# EasyEDA Pro project kuafu01_030内部老化方案_4.eprj, board PCB4 (continued)
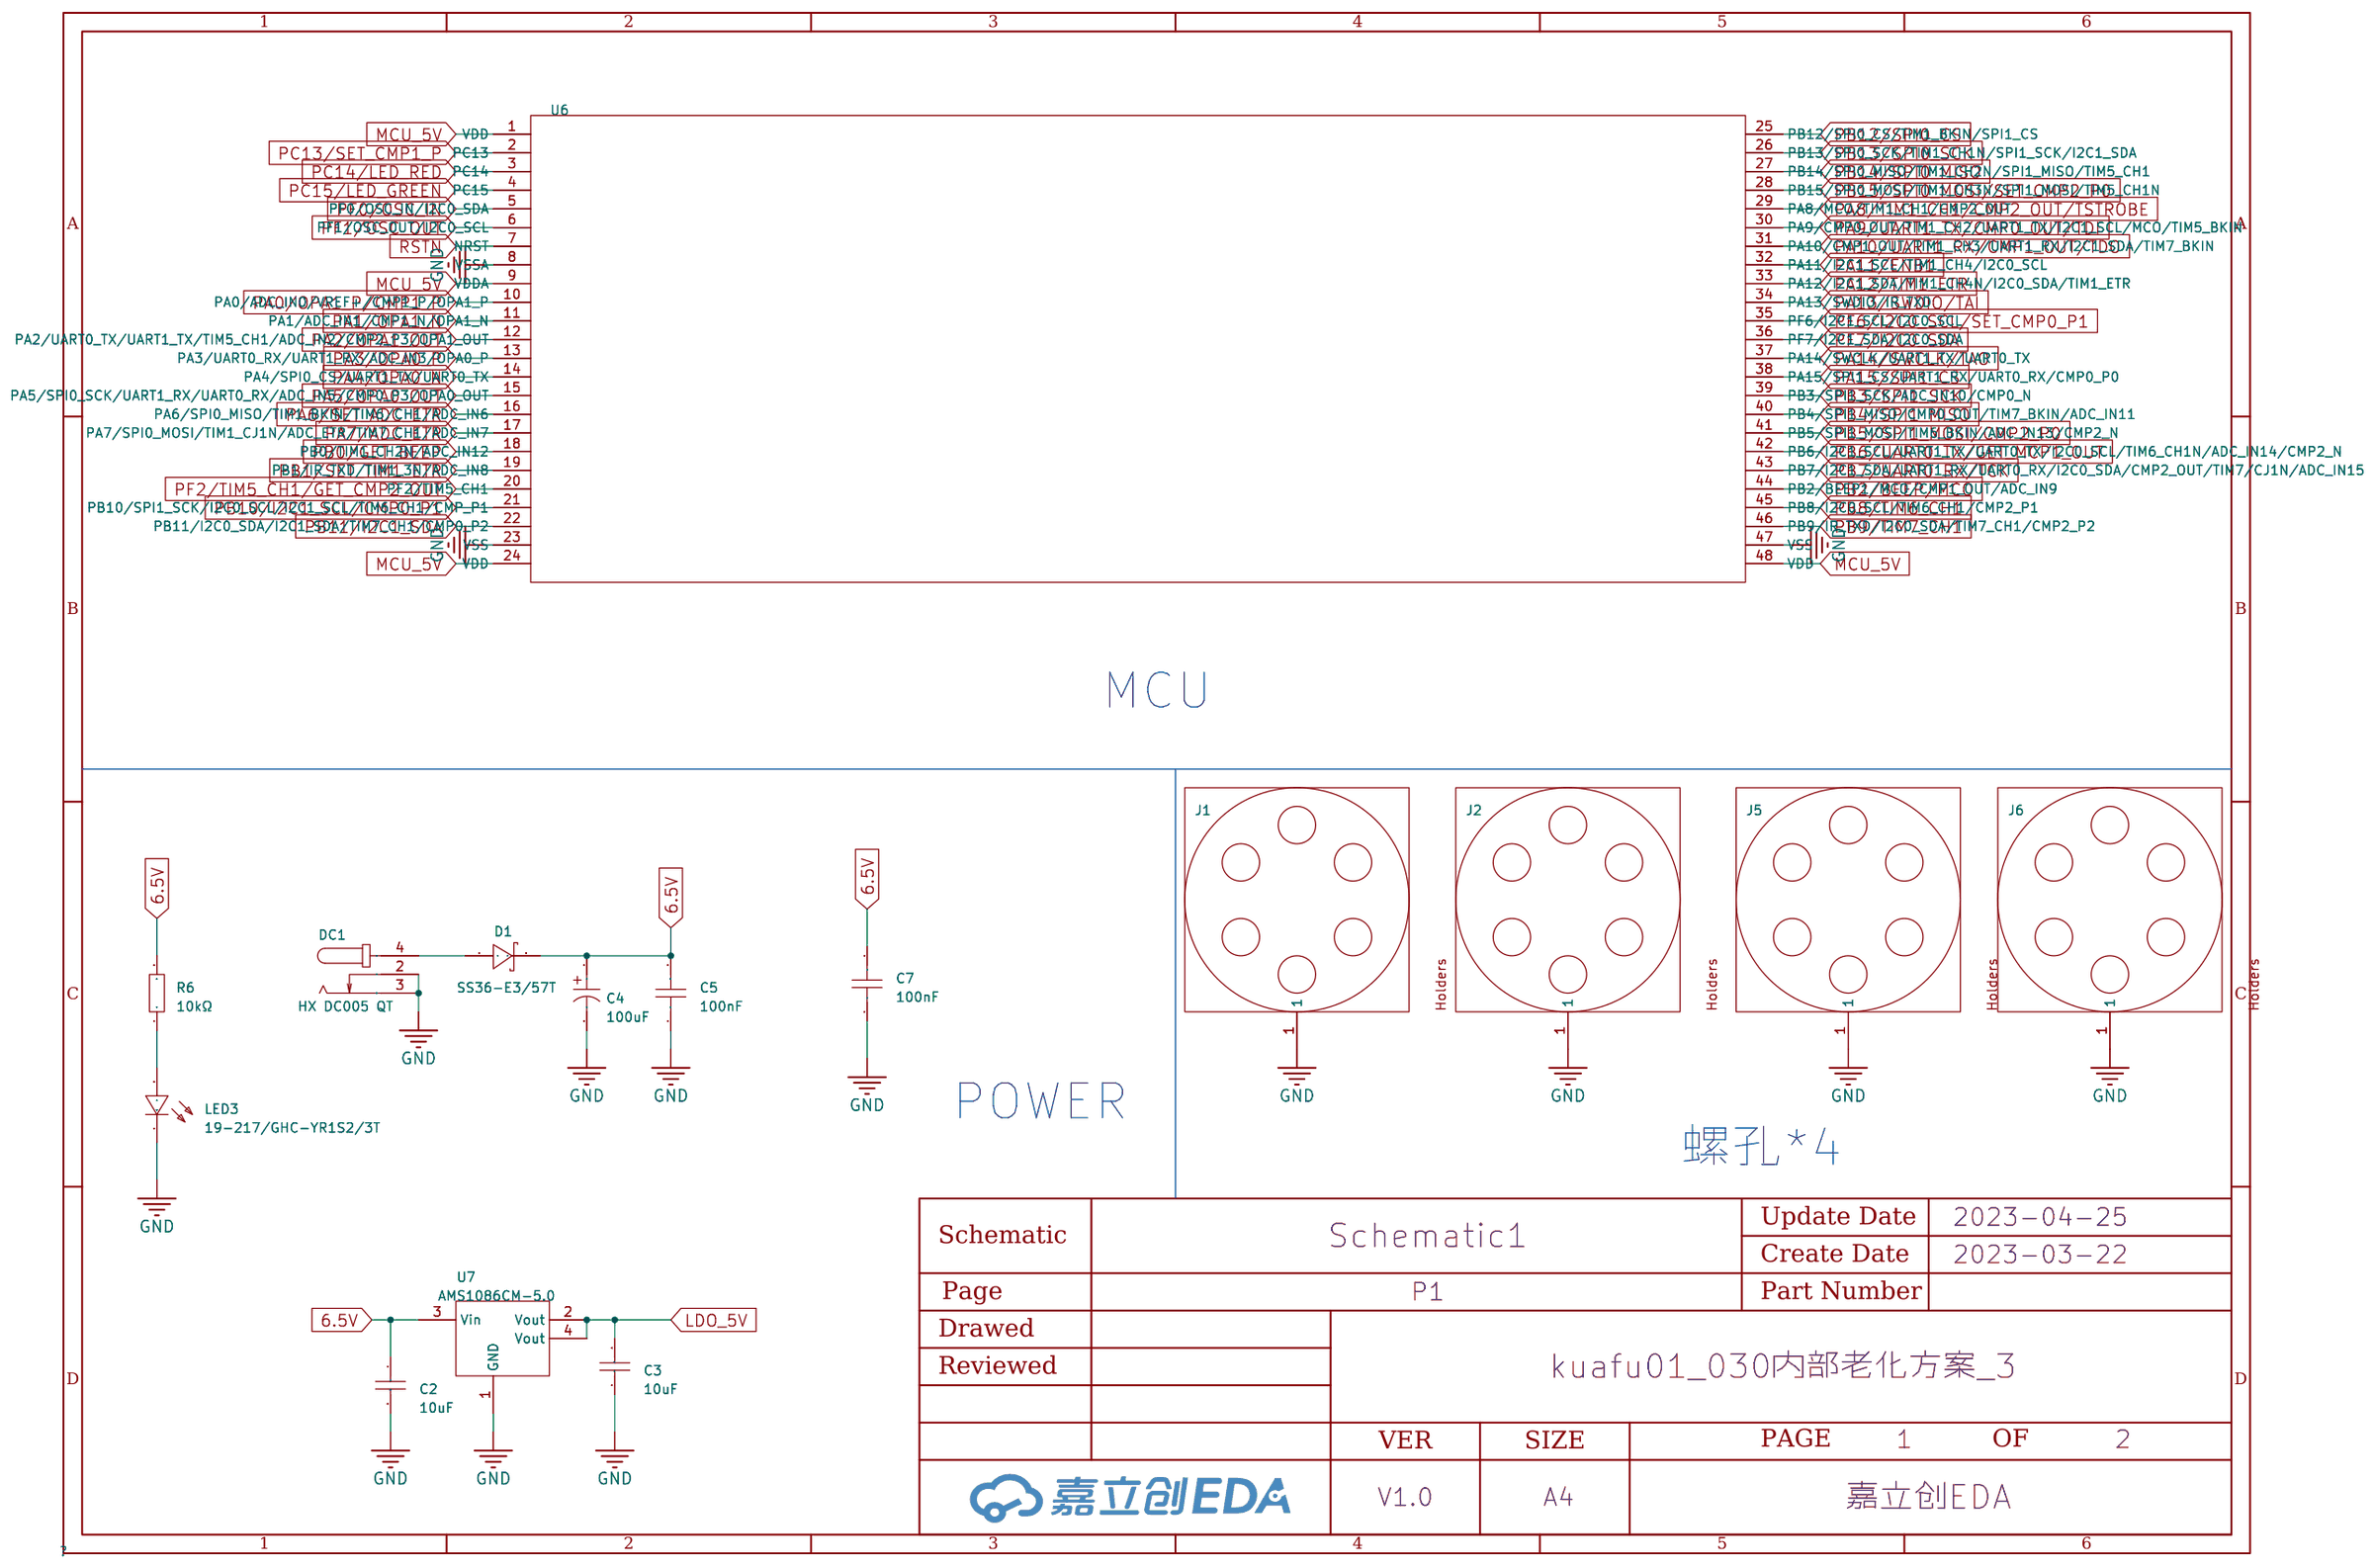
[diagram p0: P1]
## Placement (name value [footprint] x y rotation side) (continued)
H7#20  -  [HDR-TH_2P-P2.54-V-M]  16 90.68 0 top
H7#21  -  [HDR-TH_2P-P2.54-V-M]  66.55 90.68 0 top
H7#22  -  [HDR-TH_2P-P2.54-V-M]  167.64 90.68 0 top
H7#23  -  [HDR-TH_2P-P2.54-V-M]  16 15.49 0 top
H7#24  -  [HDR-TH_2P-P2.54-V-M]  218.19 15.49 0 top
H7#25  -  [HDR-TH_2P-P2.54-V-M]  16 241.05 0 top
H7#26  -  [HDR-TH_2P-P2.54-V-M]  167.64 241.05 0 top
H7#27  -  [HDR-TH_2P-P2.54-V-M]  218.19 241.05 0 top
H7#28  -  [HDR-TH_2P-P2.54-V-M]  117.09 203.45 0 top
H7#29  -  [HDR-TH_2P-P2.54-V-M]  66.55 203.45 0 top
H7#30  -  [HDR-TH_2P-P2.54-V-M]  218.19 203.45 0 top
H7#31  -  [HDR-TH_2P-P2.54-V-M]  16 203.45 0 top
H7#32  -  [HDR-TH_2P-P2.54-V-M]  167.64 203.45 0 top
H8  PZ254V-11-02P  [HDR-TH_2P-P2.54-V-M]  218.19 120.65 0 top
H8#2  -  [HDR-TH_2P-P2.54-V-M]  16 158.24 0 top
H8#3  -  [HDR-TH_2P-P2.54-V-M]  117.09 120.65 0 top
H8#4  -  [HDR-TH_2P-P2.54-V-M]  218.19 158.24 0 top
H8#5  -  [HDR-TH_2P-P2.54-V-M]  16 120.65 0 top
H8#6  -  [HDR-TH_2P-P2.54-V-M]  117.09 158.24 0 top
H8#7  -  [HDR-TH_2P-P2.54-V-M]  167.64 158.24 0 top
H8#8  -  [HDR-TH_2P-P2.54-V-M]  117.09 233.43 0 top
H8#9  -  [HDR-TH_2P-P2.54-V-M]  66.55 120.65 0 top
H8#10  -  [HDR-TH_2P-P2.54-V-M]  167.64 120.65 0 top
H8#11  -  [HDR-TH_2P-P2.54-V-M]  66.55 158.24 0 top
H8#12  -  [HDR-TH_2P-P2.54-V-M]  218.19 45.47 0 top
H8#13  -  [HDR-TH_2P-P2.54-V-M]  16 83.06 0 top
H8#14  -  [HDR-TH_2P-P2.54-V-M]  117.09 45.47 0 top
H8#15  -  [HDR-TH_2P-P2.54-V-M]  16 45.47 0 top
H8#16  -  [HDR-TH_2P-P2.54-V-M]  117.09 83.06 0 top
H8#17  -  [HDR-TH_2P-P2.54-V-M]  167.64 83.06 0 top
H8#18  -  [HDR-TH_2P-P2.54-V-M]  218.19 83.06 0 top
H8#19  -  [HDR-TH_2P-P2.54-V-M]  66.55 45.47 0 top
H8#20  -  [HDR-TH_2P-P2.54-V-M]  167.64 45.47 0 top
H8#21  -  [HDR-TH_2P-P2.54-V-M]  66.55 83.06 0 top
H8#22  -  [HDR-TH_2P-P2.54-V-M]  16 7.87 0 top
H8#23  -  [HDR-TH_2P-P2.54-V-M]  218.19 7.87 0 top
H8#24  -  [HDR-TH_2P-P2.54-V-M]  167.64 233.43 0 top
H8#25  -  [HDR-TH_2P-P2.54-V-M]  16 233.43 0 top
H8#26  -  [HDR-TH_2P-P2.54-V-M]  218.19 233.43 0 top
H8#27  -  [HDR-TH_2P-P2.54-V-M]  16 195.83 0 top
H8#28  -  [HDR-TH_2P-P2.54-V-M]  117.09 195.83 0 top
H8#29  -  [HDR-TH_2P-P2.54-V-M]  66.55 233.43 0 top
H8#30  -  [HDR-TH_2P-P2.54-V-M]  167.64 195.83 0 top
H8#31  -  [HDR-TH_2P-P2.54-V-M]  218.19 195.83 0 top
H8#32  -  [HDR-TH_2P-P2.54-V-M]  66.55 195.83 0 top
H9  PZ254V-11-02P  [HDR-TH_2P-P2.54-V-M]  16 93.22 0 top
H9#2  -  [HDR-TH_2P-P2.54-V-M]  16 55.63 0 top
H9#3  -  [HDR-TH_2P-P2.54-V-M]  66.55 243.59 0 top
H9#4  -  [HDR-TH_2P-P2.54-V-M]  16 168.4 0 top
H9#5  -  [HDR-TH_2P-P2.54-V-M]  16 130.81 0 top
H9#6  -  [HDR-TH_2P-P2.54-V-M]  117.09 130.81 0 top
H9#7  -  [HDR-TH_2P-P2.54-V-M]  66.55 130.81 0 top
H9#8  -  [HDR-TH_2P-P2.54-V-M]  218.19 130.81 0 top
H9#9  -  [HDR-TH_2P-P2.54-V-M]  218.19 168.4 0 top
H9#10  -  [HDR-TH_2P-P2.54-V-M]  66.55 168.4 0 top
H9#11  -  [HDR-TH_2P-P2.54-V-M]  167.64 130.81 0 top
H9#12  -  [HDR-TH_2P-P2.54-V-M]  117.09 168.4 0 top
H9#13  -  [HDR-TH_2P-P2.54-V-M]  167.64 168.4 0 top
H9#14  -  [HDR-TH_2P-P2.54-V-M]  117.09 243.59 0 top
H9#15  -  [HDR-TH_2P-P2.54-V-M]  117.09 55.63 0 top
H9#16  -  [HDR-TH_2P-P2.54-V-M]  66.55 55.63 0 top
H9#17  -  [HDR-TH_2P-P2.54-V-M]  218.19 55.63 0 top
H9#18  -  [HDR-TH_2P-P2.54-V-M]  218.19 93.22 0 top
H9#19  -  [HDR-TH_2P-P2.54-V-M]  66.55 93.22 0 top
H9#20  -  [HDR-TH_2P-P2.54-V-M]  167.64 55.63 0 top
H9#21  -  [HDR-TH_2P-P2.54-V-M]  117.09 93.22 0 top
H9#22  -  [HDR-TH_2P-P2.54-V-M]  167.64 93.22 0 top
H9#23  -  [HDR-TH_2P-P2.54-V-M]  16 18.03 0 top
H9#24  -  [HDR-TH_2P-P2.54-V-M]  218.19 18.03 0 top
H9#25  -  [HDR-TH_2P-P2.54-V-M]  16 243.59 0 top
H9#26  -  [HDR-TH_2P-P2.54-V-M]  167.64 243.59 0 top
H9#27  -  [HDR-TH_2P-P2.54-V-M]  218.19 243.59 0 top
H9#28  -  [HDR-TH_2P-P2.54-V-M]  66.55 205.99 0 top
H9#29  -  [HDR-TH_2P-P2.54-V-M]  16 205.99 0 top
H9#30  -  [HDR-TH_2P-P2.54-V-M]  218.19 205.99 0 top
H9#31  -  [HDR-TH_2P-P2.54-V-M]  117.09 205.99 0 top
H9#32  -  [HDR-TH_2P-P2.54-V-M]  167.64 205.99 0 top
H10  PZ254V-11-02P  [HDR-TH_2P-P2.54-V-M]  16 95.76 180 top
H10#2  -  [HDR-TH_2P-P2.54-V-M]  16 58.17 180 top
H10#3  -  [HDR-TH_2P-P2.54-V-M]  66.55 246.13 180 top
H10#4  -  [HDR-TH_2P-P2.54-V-M]  16 170.94 180 top
H10#5  -  [HDR-TH_2P-P2.54-V-M]  16 133.35 180 top
H10#6  -  [HDR-TH_2P-P2.54-V-M]  117.09 133.35 180 top
H10#7  -  [HDR-TH_2P-P2.54-V-M]  66.55 133.35 180 top
H10#8  -  [HDR-TH_2P-P2.54-V-M]  218.19 133.35 180 top
H10#9  -  [HDR-TH_2P-P2.54-V-M]  167.64 133.35 180 top
H10#10  -  [HDR-TH_2P-P2.54-V-M]  218.19 170.94 180 top
H10#11  -  [HDR-TH_2P-P2.54-V-M]  66.55 170.94 180 top
H10#12  -  [HDR-TH_2P-P2.54-V-M]  117.09 170.94 180 top
H10#13  -  [HDR-TH_2P-P2.54-V-M]  167.64 170.94 180 top
H10#14  -  [HDR-TH_2P-P2.54-V-M]  117.09 246.13 180 top
H10#15  -  [HDR-TH_2P-P2.54-V-M]  117.09 58.17 180 top
H10#16  -  [HDR-TH_2P-P2.54-V-M]  66.55 58.17 180 top
H10#17  -  [HDR-TH_2P-P2.54-V-M]  218.19 58.17 180 top
H10#18  -  [HDR-TH_2P-P2.54-V-M]  167.64 58.17 180 top
H10#19  -  [HDR-TH_2P-P2.54-V-M]  218.19 95.76 180 top
H10#20  -  [HDR-TH_2P-P2.54-V-M]  66.55 95.76 180 top
H10#21  -  [HDR-TH_2P-P2.54-V-M]  117.09 95.76 180 top
H10#22  -  [HDR-TH_2P-P2.54-V-M]  167.64 95.76 180 top
H10#23  -  [HDR-TH_2P-P2.54-V-M]  16 20.57 180 top
H10#24  -  [HDR-TH_2P-P2.54-V-M]  218.19 20.57 180 top
H10#25  -  [HDR-TH_2P-P2.54-V-M]  16 246.13 180 top
H10#26  -  [HDR-TH_2P-P2.54-V-M]  167.64 246.13 180 top
H10#27  -  [HDR-TH_2P-P2.54-V-M]  218.19 246.13 180 top
H10#28  -  [HDR-TH_2P-P2.54-V-M]  66.55 208.53 180 top
H10#29  -  [HDR-TH_2P-P2.54-V-M]  16 208.53 180 top
H10#30  -  [HDR-TH_2P-P2.54-V-M]  218.19 208.53 180 top
H10#31  -  [HDR-TH_2P-P2.54-V-M]  117.09 208.53 180 top
H10#32  -  [HDR-TH_2P-P2.54-V-M]  167.64 208.53 180 top
H11  PZ254V-11-02P  [HDR-TH_2P-P2.54-V-M]  96.01 243.59 0 top
H11#2  -  [HDR-TH_2P-P2.54-V-M]  45.47 130.81 0 top
H11#3  -  [HDR-TH_2P-P2.54-V-M]  247.65 168.4 0 top
H11#4  -  [HDR-TH_2P-P2.54-V-M]  146.56 130.81 0 top
H11#5  -  [HDR-TH_2P-P2.54-V-M]  45.47 168.4 0 top
H11#6  -  [HDR-TH_2P-P2.54-V-M]  247.65 130.81 0 top
H11#7  -  [HDR-TH_2P-P2.54-V-M]  197.1 130.81 0 top
H11#8  -  [HDR-TH_2P-P2.54-V-M]  146.56 168.4 0 top
H11#9  -  [HDR-TH_2P-P2.54-V-M]  96.01 130.81 0 top
H11#10  -  [HDR-TH_2P-P2.54-V-M]  197.1 168.4 0 top
H11#11  -  [HDR-TH_2P-P2.54-V-M]  96.01 168.4 0 top
H11#12  -  [HDR-TH_2P-P2.54-V-M]  45.47 55.63 0 top
H11#13  -  [HDR-TH_2P-P2.54-V-M]  146.56 243.59 0 top
H11#14  -  [HDR-TH_2P-P2.54-V-M]  247.65 93.22 0 top
H11#15  -  [HDR-TH_2P-P2.54-V-M]  146.56 55.63 0 top
H11#16  -  [HDR-TH_2P-P2.54-V-M]  45.47 93.22 0 top
H11#17  -  [HDR-TH_2P-P2.54-V-M]  247.65 55.63 0 top
H11#18  -  [HDR-TH_2P-P2.54-V-M]  197.1 55.63 0 top
H11#19  -  [HDR-TH_2P-P2.54-V-M]  146.56 93.22 0 top
H11#20  -  [HDR-TH_2P-P2.54-V-M]  96.01 55.63 0 top
H11#21  -  [HDR-TH_2P-P2.54-V-M]  197.1 93.22 0 top
H11#22  -  [HDR-TH_2P-P2.54-V-M]  96.01 93.22 0 top
H11#23  -  [HDR-TH_2P-P2.54-V-M]  45.47 18.03 0 top
H11#24  -  [HDR-TH_2P-P2.54-V-M]  247.65 18.03 0 top
H11#25  -  [HDR-TH_2P-P2.54-V-M]  45.47 243.59 0 top
H11#26  -  [HDR-TH_2P-P2.54-V-M]  197.1 243.59 0 top
H11#27  -  [HDR-TH_2P-P2.54-V-M]  247.65 243.59 0 top
H11#28  -  [HDR-TH_2P-P2.54-V-M]  247.65 205.99 0 top
H11#29  -  [HDR-TH_2P-P2.54-V-M]  45.47 205.99 0 top
H11#30  -  [HDR-TH_2P-P2.54-V-M]  146.56 205.99 0 top
H11#31  -  [HDR-TH_2P-P2.54-V-M]  197.1 205.99 0 top
H11#32  -  [HDR-TH_2P-P2.54-V-M]  96.01 205.99 0 top
H12  PZ254V-11-02P  [HDR-TH_2P-P2.54-V-M]  96.01 246.13 0 top
H12#2  -  [HDR-TH_2P-P2.54-V-M]  247.65 170.94 0 top
H12#3  -  [HDR-TH_2P-P2.54-V-M]  146.56 133.35 0 top
H12#4  -  [HDR-TH_2P-P2.54-V-M]  96.01 133.35 0 top
H12#5  -  [HDR-TH_2P-P2.54-V-M]  45.47 170.94 0 top
H12#6  -  [HDR-TH_2P-P2.54-V-M]  247.65 133.35 0 top
H12#7  -  [HDR-TH_2P-P2.54-V-M]  197.1 170.94 0 top
H12#8  -  [HDR-TH_2P-P2.54-V-M]  45.47 133.35 0 top
H12#9  -  [HDR-TH_2P-P2.54-V-M]  197.1 133.35 0 top
H12#10  -  [HDR-TH_2P-P2.54-V-M]  146.56 170.94 0 top
H12#11  -  [HDR-TH_2P-P2.54-V-M]  96.01 170.94 0 top
H12#12  -  [HDR-TH_2P-P2.54-V-M]  146.56 246.13 0 top
H12#13  -  [HDR-TH_2P-P2.54-V-M]  247.65 95.76 0 top
H12#14  -  [HDR-TH_2P-P2.54-V-M]  146.56 58.17 0 top
H12#15  -  [HDR-TH_2P-P2.54-V-M]  96.01 58.17 0 top
H12#16  -  [HDR-TH_2P-P2.54-V-M]  45.47 95.76 0 top
H12#17  -  [HDR-TH_2P-P2.54-V-M]  247.65 58.17 0 top
H12#18  -  [HDR-TH_2P-P2.54-V-M]  197.1 95.76 0 top
H12#19  -  [HDR-TH_2P-P2.54-V-M]  45.47 58.17 0 top
H12#20  -  [HDR-TH_2P-P2.54-V-M]  197.1 58.17 0 top
H12#21  -  [HDR-TH_2P-P2.54-V-M]  146.56 95.76 0 top
H12#22  -  [HDR-TH_2P-P2.54-V-M]  96.01 95.76 0 top
H12#23  -  [HDR-TH_2P-P2.54-V-M]  45.47 20.57 0 top
H12#24  -  [HDR-TH_2P-P2.54-V-M]  247.65 20.57 0 top
H12#25  -  [HDR-TH_2P-P2.54-V-M]  45.47 246.13 0 top
H12#26  -  [HDR-TH_2P-P2.54-V-M]  197.1 246.13 0 top
H12#27  -  [HDR-TH_2P-P2.54-V-M]  247.65 246.13 0 top
H12#28  -  [HDR-TH_2P-P2.54-V-M]  247.65 208.53 0 top
H12#29  -  [HDR-TH_2P-P2.54-V-M]  45.47 208.53 0 top
H12#30  -  [HDR-TH_2P-P2.54-V-M]  197.1 208.53 0 top
H12#31  -  [HDR-TH_2P-P2.54-V-M]  146.56 208.53 0 top
H12#32  -  [HDR-TH_2P-P2.54-V-M]  96.01 208.53 0 top
H13  PZ254V-11-02P  [HDR-TH_2P-P2.54-V-M]  96.01 230.89 0 top
H13#2  -  [HDR-TH_2P-P2.54-V-M]  45.47 155.7 0 top
H13#3  -  [HDR-TH_2P-P2.54-V-M]  45.47 118.11 0 top
H13#4  -  [HDR-TH_2P-P2.54-V-M]  96.01 118.11 0 top
H13#5  -  [HDR-TH_2P-P2.54-V-M]  146.56 118.11 0 top
H13#6  -  [HDR-TH_2P-P2.54-V-M]  197.1 118.11 0 top
H13#7  -  [HDR-TH_2P-P2.54-V-M]  247.65 155.7 0 top
H13#8  -  [HDR-TH_2P-P2.54-V-M]  96.01 155.7 0 top
H13#9  -  [HDR-TH_2P-P2.54-V-M]  247.65 118.11 0 top
H13#10  -  [HDR-TH_2P-P2.54-V-M]  146.56 155.7 0 top
H13#11  -  [HDR-TH_2P-P2.54-V-M]  146.56 230.89 0 top
H13#12  -  [HDR-TH_2P-P2.54-V-M]  197.1 155.7 0 top
H13#13  -  [HDR-TH_2P-P2.54-V-M]  45.47 80.52 0 top
H13#14  -  [HDR-TH_2P-P2.54-V-M]  45.47 42.93 0 top
H13#15  -  [HDR-TH_2P-P2.54-V-M]  96.01 42.93 0 top
H13#16  -  [HDR-TH_2P-P2.54-V-M]  146.56 42.93 0 top
H13#17  -  [HDR-TH_2P-P2.54-V-M]  197.1 42.93 0 top
H13#18  -  [HDR-TH_2P-P2.54-V-M]  247.65 80.52 0 top
H13#19  -  [HDR-TH_2P-P2.54-V-M]  96.01 80.52 0 top
H13#20  -  [HDR-TH_2P-P2.54-V-M]  247.65 42.93 0 top
H13#21  -  [HDR-TH_2P-P2.54-V-M]  146.56 80.52 0 top
H13#22  -  [HDR-TH_2P-P2.54-V-M]  197.1 80.52 0 top
H13#23  -  [HDR-TH_2P-P2.54-V-M]  45.47 5.33 0 top
H13#24  -  [HDR-TH_2P-P2.54-V-M]  247.65 5.33 0 top
H13#25  -  [HDR-TH_2P-P2.54-V-M]  197.1 230.89 0 top
H13#26  -  [HDR-TH_2P-P2.54-V-M]  45.47 230.89 0 top
H13#27  -  [HDR-TH_2P-P2.54-V-M]  247.65 230.89 0 top
H13#28  -  [HDR-TH_2P-P2.54-V-M]  45.47 193.29 0 top
H13#29  -  [HDR-TH_2P-P2.54-V-M]  247.65 193.29 0 top
H13#30  -  [HDR-TH_2P-P2.54-V-M]  197.1 193.29 0 top
H13#31  -  [HDR-TH_2P-P2.54-V-M]  96.01 193.29 0 top
H13#32  -  [HDR-TH_2P-P2.54-V-M]  146.56 193.29 0 top
H14  PZ254V-11-02P  [HDR-TH_2P-P2.54-V-M]  218.19 118.11 180 top
H14#2  -  [HDR-TH_2P-P2.54-V-M]  66.55 155.7 180 top
H14#3  -  [HDR-TH_2P-P2.54-V-M]  117.09 118.11 180 top
H14#4  -  [HDR-TH_2P-P2.54-V-M]  16 118.11 180 top
H14#5  -  [HDR-TH_2P-P2.54-V-M]  117.09 155.7 180 top
H14#6  -  [HDR-TH_2P-P2.54-V-M]  66.55 118.11 180 top
H14#7  -  [HDR-TH_2P-P2.54-V-M]  16 155.7 180 top
H14#8  -  [HDR-TH_2P-P2.54-V-M]  167.64 118.11 180 top
H14#9  -  [HDR-TH_2P-P2.54-V-M]  167.64 155.7 180 top
H14#10  -  [HDR-TH_2P-P2.54-V-M]  117.09 230.89 180 top
H14#11  -  [HDR-TH_2P-P2.54-V-M]  218.19 155.7 180 top
H14#12  -  [HDR-TH_2P-P2.54-V-M]  218.19 42.93 180 top
H14#13  -  [HDR-TH_2P-P2.54-V-M]  66.55 80.52 180 top
H14#14  -  [HDR-TH_2P-P2.54-V-M]  117.09 42.93 180 top
H14#15  -  [HDR-TH_2P-P2.54-V-M]  16 42.93 180 top
H14#16  -  [HDR-TH_2P-P2.54-V-M]  117.09 80.52 180 top
H14#17  -  [HDR-TH_2P-P2.54-V-M]  66.55 42.93 180 top
H14#18  -  [HDR-TH_2P-P2.54-V-M]  16 80.52 180 top
H14#19  -  [HDR-TH_2P-P2.54-V-M]  167.64 42.93 180 top
H14#20  -  [HDR-TH_2P-P2.54-V-M]  167.64 80.52 180 top
H14#21  -  [HDR-TH_2P-P2.54-V-M]  218.19 80.52 180 top
H14#22  -  [HDR-TH_2P-P2.54-V-M]  16 5.33 180 top
H14#23  -  [HDR-TH_2P-P2.54-V-M]  218.19 5.33 180 top
H14#24  -  [HDR-TH_2P-P2.54-V-M]  167.64 230.89 180 top
H14#25  -  [HDR-TH_2P-P2.54-V-M]  16 230.89 180 top
H14#26  -  [HDR-TH_2P-P2.54-V-M]  218.19 230.89 180 top
H14#27  -  [HDR-TH_2P-P2.54-V-M]  66.55 193.29 180 top
H14#28  -  [HDR-TH_2P-P2.54-V-M]  167.64 193.29 180 top
H14#29  -  [HDR-TH_2P-P2.54-V-M]  117.09 193.29 180 top
H14#30  -  [HDR-TH_2P-P2.54-V-M]  66.55 230.89 180 top
H14#31  -  [HDR-TH_2P-P2.54-V-M]  16 193.29 180 top
H14#32  -  [HDR-TH_2P-P2.54-V-M]  218.19 193.29 180 top
J2  -  [DEMO板安装孔]  8.64 253.49 0 top
J2#2  -  [DEMO板安装孔]  251.21 256.29 0 top
J2#3  -  [DEMO板安装孔]  251.46 28.7 0 top
J2#4  -  [DEMO板安装孔]  8.64 29.97 0 top
LED1  NCD0603R1  [LED0603-RD_RED]  209.13 165.88 180 top
LED1#2  -  [LED0603-RD_RED]  108.03 128.29 180 top
LED1#3  -  [LED0603-RD_RED]  57.49 165.88 180 top
LED1#4  -  [LED0603-RD_RED]  6.94 128.29 180 top
LED1#5  -  [LED0603-RD_RED]  6.94 165.88 180 top
LED1#6  -  [LED0603-RD_RED]  108.03 241.07 180 top
LED1#7  -  [LED0603-RD_RED]  209.13 128.29 180 top
LED1#8  -  [LED0603-RD_RED]  158.58 165.88 180 top
LED1#9  -  [LED0603-RD_RED]  57.49 128.29 180 top
LED1#10  -  [LED0603-RD_RED]  158.58 128.29 180 top
LED1#11  -  [LED0603-RD_RED]  108.03 165.88 180 top
LED1#12  -  [LED0603-RD_RED]  209.13 90.7 180 top
LED1#13  -  [LED0603-RD_RED]  108.03 53.11 180 top
LED1#14  -  [LED0603-RD_RED]  57.49 90.7 180 top
LED1#15  -  [LED0603-RD_RED]  6.94 53.11 180 top
LED1#16  -  [LED0603-RD_RED]  6.94 90.7 180 top
LED1#17  -  [LED0603-RD_RED]  209.13 53.11 180 top
LED1#18  -  [LED0603-RD_RED]  158.58 90.7 180 top
LED1#19  -  [LED0603-RD_RED]  57.49 53.11 180 top
LED1#20  -  [LED0603-RD_RED]  158.58 53.11 180 top
LED1#21  -  [LED0603-RD_RED]  158.58 241.07 180 top
LED1#22  -  [LED0603-RD_RED]  108.03 90.7 180 top
LED1#23  -  [LED0603-RD_RED]  6.94 241.07 180 top
LED1#24  -  [LED0603-RD_RED]  6.94 15.52 180 top
LED1#25  -  [LED0603-RD_RED]  209.13 15.52 180 top
LED1#26  -  [LED0603-RD_RED]  209.13 241.07 180 top
LED1#27  -  [LED0603-RD_RED]  57.49 241.07 180 top
LED1#28  -  [LED0603-RD_RED]  57.49 203.48 180 top
LED1#29  -  [LED0603-RD_RED]  209.13 203.48 180 top
LED1#30  -  [LED0603-RD_RED]  6.94 203.48 180 top
LED1#31  -  [LED0603-RD_RED]  108.03 203.48 180 top
LED1#32  -  [LED0603-RD_RED]  158.58 203.48 180 top
LED2  19-217/GHC-YR1S2/3T  [LED0603-RD]  108.01 125.43 180 top
LED2#2  -  [LED0603-RD]  6.92 125.43 180 top
LED2#3  -  [LED0603-RD]  57.46 238.21 180 top
LED2#4  -  [LED0603-RD]  6.92 163.03 180 top
LED2#5  -  [LED0603-RD]  209.1 125.43 180 top
LED2#6  -  [LED0603-RD]  57.46 125.43 180 top
LED2#7  -  [LED0603-RD]  209.1 163.03 180 top
LED2#8  -  [LED0603-RD]  57.46 163.03 180 top
LED2#9  -  [LED0603-RD]  158.56 125.43 180 top
LED2#10  -  [LED0603-RD]  158.56 163.03 180 top
LED2#11  -  [LED0603-RD]  108.01 163.03 180 top
LED2#12  -  [LED0603-RD]  108.01 50.25 180 top
LED2#13  -  [LED0603-RD]  6.92 50.25 180 top
LED2#14  -  [LED0603-RD]  108.01 238.21 180 top
LED2#15  -  [LED0603-RD]  6.92 87.84 180 top
LED2#16  -  [LED0603-RD]  209.1 50.25 180 top
LED2#17  -  [LED0603-RD]  57.46 50.25 180 top
LED2#18  -  [LED0603-RD]  209.1 87.84 180 top
LED2#19  -  [LED0603-RD]  57.46 87.84 180 top
LED2#20  -  [LED0603-RD]  158.56 50.25 180 top
LED2#21  -  [LED0603-RD]  158.56 87.84 180 top
LED2#22  -  [LED0603-RD]  108.01 87.84 180 top
LED2#23  -  [LED0603-RD]  6.92 238.21 180 top
LED2#24  -  [LED0603-RD]  6.92 12.66 180 top
LED2#25  -  [LED0603-RD]  209.1 12.66 180 top
LED2#26  -  [LED0603-RD]  158.56 238.21 180 top
LED2#27  -  [LED0603-RD]  209.1 238.21 180 top
LED2#28  -  [LED0603-RD]  6.92 200.62 180 top
LED2#29  -  [LED0603-RD]  209.1 200.62 180 top
LED2#30  -  [LED0603-RD]  108.01 200.62 180 top
LED2#31  -  [LED0603-RD]  57.46 200.62 180 top
LED2#32  -  [LED0603-RD]  158.56 200.62 180 top
LED3  19-217/GHC-YR1S2/3T  [LED0603-RD]  94.67 10.39 90 top
R1  10K  [R0603]  60.82 241.07 180 top
R1#2  -  [R0603]  60.82 128.29 180 top
R1#3  -  [R0603]  10.27 165.88 180 top
R1#4  -  [R0603]  10.27 128.29 180 top
R1#5  -  [R0603]  212.46 165.88 180 top
R1#6  -  [R0603]  111.36 128.29 180 top
R1#7  -  [R0603]  60.82 165.88 180 top
R1#8  -  [R0603]  212.46 128.29 180 top
R1#9  -  [R0603]  161.91 128.29 180 top
R1#10  -  [R0603]  161.91 165.88 180 top
R1#11  -  [R0603]  111.36 241.07 180 top
R1#12  -  [R0603]  111.36 165.88 180 top
R1#13  -  [R0603]  60.82 53.11 180 top
R1#14  -  [R0603]  10.27 90.7 180 top
R1#15  -  [R0603]  10.27 53.11 180 top
R1#16  -  [R0603]  212.46 90.7 180 top
R1#17  -  [R0603]  111.36 53.11 180 top
R1#18  -  [R0603]  60.82 90.7 180 top
R1#19  -  [R0603]  212.46 53.11 180 top
R1#20  -  [R0603]  161.91 53.11 180 top
R1#21  -  [R0603]  10.27 241.07 180 top
R1#22  -  [R0603]  161.91 90.7 180 top
R1#23  -  [R0603]  111.36 90.7 180 top
R1#24  -  [R0603]  10.27 15.52 180 top
R1#25  -  [R0603]  212.46 15.52 180 top
R1#26  -  [R0603]  161.91 241.07 180 top
R1#27  -  [R0603]  212.46 241.07 180 top
R1#28  -  [R0603]  10.27 203.48 180 top
R1#29  -  [R0603]  212.46 203.48 180 top
R1#30  -  [R0603]  111.36 203.48 180 top
R1#31  -  [R0603]  60.82 203.48 180 top
R1#32  -  [R0603]  161.91 203.48 180 top
R2  10K  [R0603]  60.73 238.22 180 top
R2#2  -  [R0603]  111.27 125.44 180 top
R2#3  -  [R0603]  212.37 163.03 180 top
R2#4  -  [R0603]  60.73 125.44 180 top
R2#5  -  [R0603]  10.18 163.03 180 top
R2#6  -  [R0603]  10.18 125.44 180 top
R2#7  -  [R0603]  212.37 125.44 180 top
R2#8  -  [R0603]  161.82 125.44 180 top
R2#9  -  [R0603]  161.82 163.03 180 top
R2#10  -  [R0603]  60.73 163.03 180 top
R2#11  -  [R0603]  111.27 163.03 180 top
R2#12  -  [R0603]  111.27 50.25 180 top
R2#13  -  [R0603]  212.37 87.85 180 top
R2#14  -  [R0603]  111.27 238.22 180 top
R2#15  -  [R0603]  60.73 50.25 180 top
R2#16  -  [R0603]  10.18 87.85 180 top
R2#17  -  [R0603]  10.18 50.25 180 top
R2#18  -  [R0603]  212.37 50.25 180 top
R2#19  -  [R0603]  161.82 50.25 180 top
R2#20  -  [R0603]  161.82 87.85 180 top
R2#21  -  [R0603]  10.18 238.22 180 top
R2#22  -  [R0603]  60.73 87.85 180 top
R2#23  -  [R0603]  111.27 87.85 180 top
R2#24  -  [R0603]  10.18 12.66 180 top
R2#25  -  [R0603]  212.37 12.66 180 top
R2#26  -  [R0603]  161.82 238.22 180 top
R2#27  -  [R0603]  212.37 238.22 180 top
R2#28  -  [R0603]  212.37 200.62 180 top
R2#29  -  [R0603]  111.27 200.62 180 top
R2#30  -  [R0603]  10.18 200.62 180 top
R2#31  -  [R0603]  60.73 200.62 180 top
R2#32  -  [R0603]  161.82 200.62 180 top
R3  150Ω  [R0603]  51.74 80.51 0 top
R3#2  -  [R0603]  102.29 230.88 0 top
R3#3  -  [R0603]  51.74 118.1 0 top
R3#4  -  [R0603]  51.74 155.69 0 top
R3#5  -  [R0603]  152.83 118.1 0 top
R3#6  -  [R0603]  203.38 118.1 0 top
R3#7  -  [R0603]  102.29 118.1 0 top
R3#8  -  [R0603]  102.29 155.69 0 top
R3#9  -  [R0603]  253.92 118.1 0 top
R3#10  -  [R0603]  253.92 155.69 0 top
R3#11  -  [R0603]  152.83 155.69 0 top
R3#12  -  [R0603]  152.83 230.88 0 top
R3#13  -  [R0603]  203.38 155.69 0 top
R3#14  -  [R0603]  51.74 42.92 0 top
R3#15  -  [R0603]  152.83 42.92 0 top
R3#16  -  [R0603]  203.38 42.92 0 top
R3#17  -  [R0603]  102.29 42.92 0 top
R3#18  -  [R0603]  102.29 80.51 0 top
R3#19  -  [R0603]  253.92 42.92 0 top
R3#20  -  [R0603]  253.92 80.51 0 top
R3#21  -  [R0603]  152.83 80.51 0 top
R3#22  -  [R0603]  203.38 80.51 0 top
R3#23  -  [R0603]  51.74 5.32 0 top
R3#24  -  [R0603]  253.92 5.32 0 top
R3#25  -  [R0603]  51.74 230.88 0 top
R3#26  -  [R0603]  203.38 230.88 0 top
R3#27  -  [R0603]  253.92 230.88 0 top
R3#28  -  [R0603]  253.92 193.28 0 top
R3#29  -  [R0603]  51.74 193.28 0 top
R3#30  -  [R0603]  203.38 193.28 0 top
R3#31  -  [R0603]  102.29 193.28 0 top
R3#32  -  [R0603]  152.83 193.28 0 top
R4  0603WAF4701T5E/4.7KΩ  [R0603]  102.29 243.57 180 top
R4#2  -  [R0603]  102.29 130.79 180 top
R4#3  -  [R0603]  152.83 130.79 180 top
R4#4  -  [R0603]  51.74 130.79 180 top
R4#5  -  [R0603]  203.38 130.79 180 top
R4#6  -  [R0603]  253.92 168.38 180 top
R4#7  -  [R0603]  51.74 168.38 180 top
R4#8  -  [R0603]  152.83 168.38 180 top
R4#9  -  [R0603]  102.29 168.38 180 top
R4#10  -  [R0603]  253.92 130.79 180 top
R4#11  -  [R0603]  203.38 168.38 180 top
R4#12  -  [R0603]  253.92 55.61 180 top
R4#13  -  [R0603]  152.83 243.57 180 top
R4#14  -  [R0603]  102.29 55.61 180 top
R4#15  -  [R0603]  152.83 55.61 180 top
R4#16  -  [R0603]  51.74 55.61 180 top
R4#17  -  [R0603]  203.38 55.61 180 top
R4#18  -  [R0603]  253.92 93.2 180 top
R4#19  -  [R0603]  51.74 93.2 180 top
R4#20  -  [R0603]  152.83 93.2 180 top
R4#21  -  [R0603]  102.29 93.2 180 top
R4#22  -  [R0603]  203.38 93.2 180 top
R4#23  -  [R0603]  51.74 243.57 180 top
R4#24  -  [R0603]  51.74 18.01 180 top
R4#25  -  [R0603]  253.92 18.01 180 top
R4#26  -  [R0603]  203.38 243.57 180 top
R4#27  -  [R0603]  253.92 243.57 180 top
R4#28  -  [R0603]  253.92 205.97 180 top
R4#29  -  [R0603]  51.74 205.97 180 top
R4#30  -  [R0603]  152.83 205.97 180 top
R4#31  -  [R0603]  102.29 205.97 180 top
R4#32  -  [R0603]  203.38 205.97 180 top
R5  0603WAF4701T5E/4.7KΩ  [R0603]  102.28 246 0 top
R5#2  -  [R0603]  152.82 133.23 0 top
R5#3  -  [R0603]  51.73 170.82 0 top
R5#4  -  [R0603]  253.91 133.23 0 top
R5#5  -  [R0603]  253.91 170.82 0 top
R5#6  -  [R0603]  51.73 133.23 0 top
R5#7  -  [R0603]  102.28 133.23 0 top
R5#8  -  [R0603]  203.37 133.23 0 top
R5#9  -  [R0603]  152.82 170.82 0 top
R5#10  -  [R0603]  102.28 170.82 0 top
R5#11  -  [R0603]  203.37 170.82 0 top
R5#12  -  [R0603]  152.82 246 0 top
R5#13  -  [R0603]  152.82 58.04 0 top
R5#14  -  [R0603]  51.73 95.63 0 top
R5#15  -  [R0603]  253.91 58.04 0 top
R5#16  -  [R0603]  253.91 95.63 0 top
R5#17  -  [R0603]  51.73 58.04 0 top
R5#18  -  [R0603]  102.28 58.04 0 top
R5#19  -  [R0603]  203.37 58.04 0 top
R5#20  -  [R0603]  152.82 95.63 0 top
R5#21  -  [R0603]  102.28 95.63 0 top
R5#22  -  [R0603]  203.37 95.63 0 top
R5#23  -  [R0603]  51.73 246 0 top
R5#24  -  [R0603]  51.73 20.45 0 top
R5#25  -  [R0603]  253.91 20.45 0 top
R5#26  -  [R0603]  203.37 246 0 top
R5#27  -  [R0603]  253.91 246 0 top
R5#28  -  [R0603]  253.91 208.41 0 top
R5#29  -  [R0603]  51.73 208.41 0 top
R5#30  -  [R0603]  152.82 208.41 0 top
R5#31  -  [R0603]  102.28 208.41 0 top
R5#32  -  [R0603]  203.37 208.41 0 top
R6  10kΩ  [R0603]  94.63 14.27 90 top
U1  REF2920AIDBZR  [SOT-23-3_L2.9-W1.3-P1.90-LS2.4-BR]  59.03 233.15 0 top
U1#2  -  [SOT-23-3_L2.9-W1.3-P1.90-LS2.4-BR]  160.12 120.38 0 top
U1#3  -  [SOT-23-3_L2.9-W1.3-P1.90-LS2.4-BR]  109.58 157.97 0 top
U1#4  -  [SOT-23-3_L2.9-W1.3-P1.90-LS2.4-BR]  8.48 120.38 0 top
U1#5  -  [SOT-23-3_L2.9-W1.3-P1.90-LS2.4-BR]  109.58 120.38 0 top
U1#6  -  [SOT-23-3_L2.9-W1.3-P1.90-LS2.4-BR]  8.48 157.97 0 top
U1#7  -  [SOT-23-3_L2.9-W1.3-P1.90-LS2.4-BR]  210.67 120.38 0 top
U1#8  -  [SOT-23-3_L2.9-W1.3-P1.90-LS2.4-BR]  210.67 157.97 0 top
U1#9  -  [SOT-23-3_L2.9-W1.3-P1.90-LS2.4-BR]  59.03 120.38 0 top
U1#10  -  [SOT-23-3_L2.9-W1.3-P1.90-LS2.4-BR]  59.03 157.97 0 top
U1#11  -  [SOT-23-3_L2.9-W1.3-P1.90-LS2.4-BR]  160.12 157.97 0 top
U1#12  -  [SOT-23-3_L2.9-W1.3-P1.90-LS2.4-BR]  109.58 233.15 0 top
U1#13  -  [SOT-23-3_L2.9-W1.3-P1.90-LS2.4-BR]  160.12 45.19 0 top
U1#14  -  [SOT-23-3_L2.9-W1.3-P1.90-LS2.4-BR]  109.58 82.79 0 top
U1#15  -  [SOT-23-3_L2.9-W1.3-P1.90-LS2.4-BR]  8.48 45.19 0 top
U1#16  -  [SOT-23-3_L2.9-W1.3-P1.90-LS2.4-BR]  109.58 45.19 0 top
U1#17  -  [SOT-23-3_L2.9-W1.3-P1.90-LS2.4-BR]  8.48 82.79 0 top
U1#18  -  [SOT-23-3_L2.9-W1.3-P1.90-LS2.4-BR]  210.67 45.19 0 top
U1#19  -  [SOT-23-3_L2.9-W1.3-P1.90-LS2.4-BR]  210.67 82.79 0 top
U1#20  -  [SOT-23-3_L2.9-W1.3-P1.90-LS2.4-BR]  59.03 45.19 0 top
U1#21  -  [SOT-23-3_L2.9-W1.3-P1.90-LS2.4-BR]  59.03 82.79 0 top
U1#22  -  [SOT-23-3_L2.9-W1.3-P1.90-LS2.4-BR]  8.48 233.15 0 top
U1#23  -  [SOT-23-3_L2.9-W1.3-P1.90-LS2.4-BR]  160.12 82.79 0 top
U1#24  -  [SOT-23-3_L2.9-W1.3-P1.90-LS2.4-BR]  8.48 7.6 0 top
U1#25  -  [SOT-23-3_L2.9-W1.3-P1.90-LS2.4-BR]  210.67 7.6 0 top
U1#26  -  [SOT-23-3_L2.9-W1.3-P1.90-LS2.4-BR]  160.12 233.15 0 top
U1#27  -  [SOT-23-3_L2.9-W1.3-P1.90-LS2.4-BR]  210.67 233.15 0 top
U1#28  -  [SOT-23-3_L2.9-W1.3-P1.90-LS2.4-BR]  109.58 195.56 0 top
U1#29  -  [SOT-23-3_L2.9-W1.3-P1.90-LS2.4-BR]  8.48 195.56 0 top
U1#30  -  [SOT-23-3_L2.9-W1.3-P1.90-LS2.4-BR]  160.12 195.56 0 top
U1#31  -  [SOT-23-3_L2.9-W1.3-P1.90-LS2.4-BR]  210.67 195.56 0 top
U1#32  -  [SOT-23-3_L2.9-W1.3-P1.90-LS2.4-BR]  59.03 195.56 0 top
U2  BL1551B  [SC-70-6_L2.1-W1.3-P0.65-LS2.3-BR]  125.44 116.84 180 top
U2#2  -  [SC-70-6_L2.1-W1.3-P0.65-LS2.3-BR]  24.34 116.84 180 top
U2#3  -  [SC-70-6_L2.1-W1.3-P0.65-LS2.3-BR]  74.89 116.84 180 top
U2#4  -  [SC-70-6_L2.1-W1.3-P0.65-LS2.3-BR]  74.89 154.43 180 top
U2#5  -  [SC-70-6_L2.1-W1.3-P0.65-LS2.3-BR]  226.53 154.43 180 top
U2#6  -  [SC-70-6_L2.1-W1.3-P0.65-LS2.3-BR]  24.34 154.43 180 top
U2#7  -  [SC-70-6_L2.1-W1.3-P0.65-LS2.3-BR]  226.53 116.84 180 top
U2#8  -  [SC-70-6_L2.1-W1.3-P0.65-LS2.3-BR]  74.89 229.61 180 top
U2#9  -  [SC-70-6_L2.1-W1.3-P0.65-LS2.3-BR]  175.98 116.84 180 top
U2#10  -  [SC-70-6_L2.1-W1.3-P0.65-LS2.3-BR]  175.98 154.43 180 top
U2#11  -  [SC-70-6_L2.1-W1.3-P0.65-LS2.3-BR]  125.44 154.43 180 top
U2#12  -  [SC-70-6_L2.1-W1.3-P0.65-LS2.3-BR]  125.44 41.65 180 top
U2#13  -  [SC-70-6_L2.1-W1.3-P0.65-LS2.3-BR]  24.34 41.65 180 top
U2#14  -  [SC-70-6_L2.1-W1.3-P0.65-LS2.3-BR]  74.89 41.65 180 top
U2#15  -  [SC-70-6_L2.1-W1.3-P0.65-LS2.3-BR]  74.89 79.25 180 top
U2#16  -  [SC-70-6_L2.1-W1.3-P0.65-LS2.3-BR]  226.53 79.25 180 top
U2#17  -  [SC-70-6_L2.1-W1.3-P0.65-LS2.3-BR]  24.34 79.25 180 top
U2#18  -  [SC-70-6_L2.1-W1.3-P0.65-LS2.3-BR]  226.53 41.65 180 top
U2#19  -  [SC-70-6_L2.1-W1.3-P0.65-LS2.3-BR]  175.98 41.65 180 top
U2#20  -  [SC-70-6_L2.1-W1.3-P0.65-LS2.3-BR]  175.98 79.25 180 top
U2#21  -  [SC-70-6_L2.1-W1.3-P0.65-LS2.3-BR]  125.44 229.61 180 top
U2#22  -  [SC-70-6_L2.1-W1.3-P0.65-LS2.3-BR]  125.44 79.25 180 top
U2#23  -  [SC-70-6_L2.1-W1.3-P0.65-LS2.3-BR]  24.34 229.61 180 top
U2#24  -  [SC-70-6_L2.1-W1.3-P0.65-LS2.3-BR]  24.34 4.06 180 top
U2#25  -  [SC-70-6_L2.1-W1.3-P0.65-LS2.3-BR]  226.53 4.06 180 top
U2#26  -  [SC-70-6_L2.1-W1.3-P0.65-LS2.3-BR]  175.98 229.61 180 top
U2#27  -  [SC-70-6_L2.1-W1.3-P0.65-LS2.3-BR]  226.53 229.61 180 top
U2#28  -  [SC-70-6_L2.1-W1.3-P0.65-LS2.3-BR]  226.53 192.02 180 top
U2#29  -  [SC-70-6_L2.1-W1.3-P0.65-LS2.3-BR]  74.89 192.02 180 top
U2#30  -  [SC-70-6_L2.1-W1.3-P0.65-LS2.3-BR]  24.34 192.02 180 top
U2#31  -  [SC-70-6_L2.1-W1.3-P0.65-LS2.3-BR]  125.44 192.02 180 top
U2#32  -  [SC-70-6_L2.1-W1.3-P0.65-LS2.3-BR]  175.98 192.02 180 top
U6  PT32A030C8T7  [LQFP-48_L7.0-W7.0-P0.50-LS9.0-BL-EP5.4]  81.38 237.86 270 top
U6#2  -  [LQFP-48_L7.0-W7.0-P0.50-LS9.0-BL-EP5.4]  131.92 125.08 270 top
U6#3  -  [LQFP-48_L7.0-W7.0-P0.50-LS9.0-BL-EP5.4]  30.83 125.08 270 top
U6#4  -  [LQFP-48_L7.0-W7.0-P0.50-LS9.0-BL-EP5.4]  233.02 125.08 270 top
U6#5  -  [LQFP-48_L7.0-W7.0-P0.50-LS9.0-BL-EP5.4]  81.38 125.08 270 top
U6#6  -  [LQFP-48_L7.0-W7.0-P0.50-LS9.0-BL-EP5.4]  233.02 162.67 270 top
U6#7  -  [LQFP-48_L7.0-W7.0-P0.50-LS9.0-BL-EP5.4]  182.47 125.08 270 top
U6#8  -  [LQFP-48_L7.0-W7.0-P0.50-LS9.0-BL-EP5.4]  131.92 162.67 270 top
U6#9  -  [LQFP-48_L7.0-W7.0-P0.50-LS9.0-BL-EP5.4]  30.83 162.67 270 top
U6#10  -  [LQFP-48_L7.0-W7.0-P0.50-LS9.0-BL-EP5.4]  182.47 162.67 270 top
U6#11  -  [LQFP-48_L7.0-W7.0-P0.50-LS9.0-BL-EP5.4]  81.38 162.67 270 top
U6#12  -  [LQFP-48_L7.0-W7.0-P0.50-LS9.0-BL-EP5.4]  131.92 237.86 270 top
U6#13  -  [LQFP-48_L7.0-W7.0-P0.50-LS9.0-BL-EP5.4]  131.92 49.9 270 top
U6#14  -  [LQFP-48_L7.0-W7.0-P0.50-LS9.0-BL-EP5.4]  30.83 49.9 270 top
U6#15  -  [LQFP-48_L7.0-W7.0-P0.50-LS9.0-BL-EP5.4]  233.02 49.9 270 top
U6#16  -  [LQFP-48_L7.0-W7.0-P0.50-LS9.0-BL-EP5.4]  81.38 49.9 270 top
U6#17  -  [LQFP-48_L7.0-W7.0-P0.50-LS9.0-BL-EP5.4]  233.02 87.49 270 top
U6#18  -  [LQFP-48_L7.0-W7.0-P0.50-LS9.0-BL-EP5.4]  182.47 49.9 270 top
U6#19  -  [LQFP-48_L7.0-W7.0-P0.50-LS9.0-BL-EP5.4]  131.92 87.49 270 top
U6#20  -  [LQFP-48_L7.0-W7.0-P0.50-LS9.0-BL-EP5.4]  30.83 87.49 270 top
U6#21  -  [LQFP-48_L7.0-W7.0-P0.50-LS9.0-BL-EP5.4]  182.47 87.49 270 top
U6#22  -  [LQFP-48_L7.0-W7.0-P0.50-LS9.0-BL-EP5.4]  81.38 87.49 270 top
U6#23  -  [LQFP-48_L7.0-W7.0-P0.50-LS9.0-BL-EP5.4]  30.83 12.31 270 top
U6#24  -  [LQFP-48_L7.0-W7.0-P0.50-LS9.0-BL-EP5.4]  233.02 12.31 270 top
U6#25  -  [LQFP-48_L7.0-W7.0-P0.50-LS9.0-BL-EP5.4]  182.47 237.86 270 top
U6#26  -  [LQFP-48_L7.0-W7.0-P0.50-LS9.0-BL-EP5.4]  233.02 237.86 270 top
U6#27  -  [LQFP-48_L7.0-W7.0-P0.50-LS9.0-BL-EP5.4]  30.83 237.86 270 top
U6#28  -  [LQFP-48_L7.0-W7.0-P0.50-LS9.0-BL-EP5.4]  233.02 200.27 270 top
U6#29  -  [LQFP-48_L7.0-W7.0-P0.50-LS9.0-BL-EP5.4]  81.38 200.27 270 top
U6#30  -  [LQFP-48_L7.0-W7.0-P0.50-LS9.0-BL-EP5.4]  131.92 200.27 270 top
U6#31  -  [LQFP-48_L7.0-W7.0-P0.50-LS9.0-BL-EP5.4]  30.83 200.27 270 top
U6#32  -  [LQFP-48_L7.0-W7.0-P0.50-LS9.0-BL-EP5.4]  182.47 200.27 270 top
U7  AMS1086CM-5.0  [TO-263-3_L8.6-W10.2-P2.54-LS14.4-TL]  108.63 17.57 0 top
U7#2  -  [TO-263-3_L8.6-W10.2-P2.54-LS14.4-TL]  136.7 17.78 0 top
X1  25MHz  [OSC-SMD_4P-L2.5-W2.0-BL]  71.12 238.25 180 top
X1#2  -  [OSC-SMD_4P-L2.5-W2.0-BL]  121.67 125.48 180 top
X1#3  -  [OSC-SMD_4P-L2.5-W2.0-BL]  20.57 125.48 180 top
X1#4  -  [OSC-SMD_4P-L2.5-W2.0-BL]  172.21 125.48 180 top
X1#5  -  [OSC-SMD_4P-L2.5-W2.0-BL]  222.76 163.07 180 top
X1#6  -  [OSC-SMD_4P-L2.5-W2.0-BL]  20.57 163.07 180 top
X1#7  -  [OSC-SMD_4P-L2.5-W2.0-BL]  222.76 125.48 180 top
X1#8  -  [OSC-SMD_4P-L2.5-W2.0-BL]  121.67 163.07 180 top
X1#9  -  [OSC-SMD_4P-L2.5-W2.0-BL]  172.21 163.07 180 top
X1#10  -  [OSC-SMD_4P-L2.5-W2.0-BL]  71.12 125.48 180 top
X1#11  -  [OSC-SMD_4P-L2.5-W2.0-BL]  71.12 163.07 180 top
X1#12  -  [OSC-SMD_4P-L2.5-W2.0-BL]  121.67 50.29 180 top
X1#13  -  [OSC-SMD_4P-L2.5-W2.0-BL]  20.57 50.29 180 top
X1#14  -  [OSC-SMD_4P-L2.5-W2.0-BL]  172.21 50.29 180 top
X1#15  -  [OSC-SMD_4P-L2.5-W2.0-BL]  222.76 87.88 180 top
X1#16  -  [OSC-SMD_4P-L2.5-W2.0-BL]  121.67 238.25 180 top
X1#17  -  [OSC-SMD_4P-L2.5-W2.0-BL]  20.57 87.88 180 top
X1#18  -  [OSC-SMD_4P-L2.5-W2.0-BL]  222.76 50.29 180 top
X1#19  -  [OSC-SMD_4P-L2.5-W2.0-BL]  121.67 87.88 180 top
X1#20  -  [OSC-SMD_4P-L2.5-W2.0-BL]  172.21 87.88 180 top
X1#21  -  [OSC-SMD_4P-L2.5-W2.0-BL]  71.12 50.29 180 top
X1#22  -  [OSC-SMD_4P-L2.5-W2.0-BL]  71.12 87.88 180 top
X1#23  -  [OSC-SMD_4P-L2.5-W2.0-BL]  20.57 238.25 180 top
X1#24  -  [OSC-SMD_4P-L2.5-W2.0-BL]  20.57 12.7 180 top
X1#25  -  [OSC-SMD_4P-L2.5-W2.0-BL]  222.76 12.7 180 top
X1#26  -  [OSC-SMD_4P-L2.5-W2.0-BL]  172.21 238.25 180 top
X1#27  -  [OSC-SMD_4P-L2.5-W2.0-BL]  222.76 238.25 180 top
X1#28  -  [OSC-SMD_4P-L2.5-W2.0-BL]  222.76 200.66 180 top
X1#29  -  [OSC-SMD_4P-L2.5-W2.0-BL]  20.57 200.66 180 top
X1#30  -  [OSC-SMD_4P-L2.5-W2.0-BL]  71.12 200.66 180 top
X1#31  -  [OSC-SMD_4P-L2.5-W2.0-BL]  121.67 200.66 180 top
X1#32  -  [OSC-SMD_4P-L2.5-W2.0-BL]  172.21 200.66 180 top

## Footprints (pads in the part's own frame, mm; a bottom-side part is the same pattern mirrored in y, then rotated)
C0603
  rect 0.8x0.9 smd: 1(-0.7,0) 2(0.7,0)
C1206
  rect 1.485x1.728 smd: 1(-1.593,0) 2(1.593,0)
CAP-SMD_BD6.3-L6.6-W6.6-LS7.6-FD-1
  rect 3.5x1.2 smd: 1(-2.67,0) 2(2.67,0)
CONN-TH_4P-P2.50_XH-4A
  rect 1.8x1.8 hole 1.199: 1(-3.751,0)
  round 1.8 hole 1.199: 2(-1.25,0) 3(1.25,0) 4(3.751,0)
DC-IN-TH_HANXIA_HX-DC005-QT
  oval 3.6x1.4 hole 3x0.8: 2(0.15,-2.3)
  oval 1.7x3.6 hole 1x3: 3(-3.15,2.3) 4(3.15,2.3)
DEMO板安装孔
  round 6.32 hole 2.75: 1(0,0)
HDR-TH_2P-P2.54-V-M
  rect 2x2 hole 1.2: 1(-1.27,0)
  round 2 hole 1.2: 2(1.27,0)
